# EasyEDA Pro project ProProject_IMUSensorNodes202312.epro, board 6_6_拼板20240123（带编号） (continued)
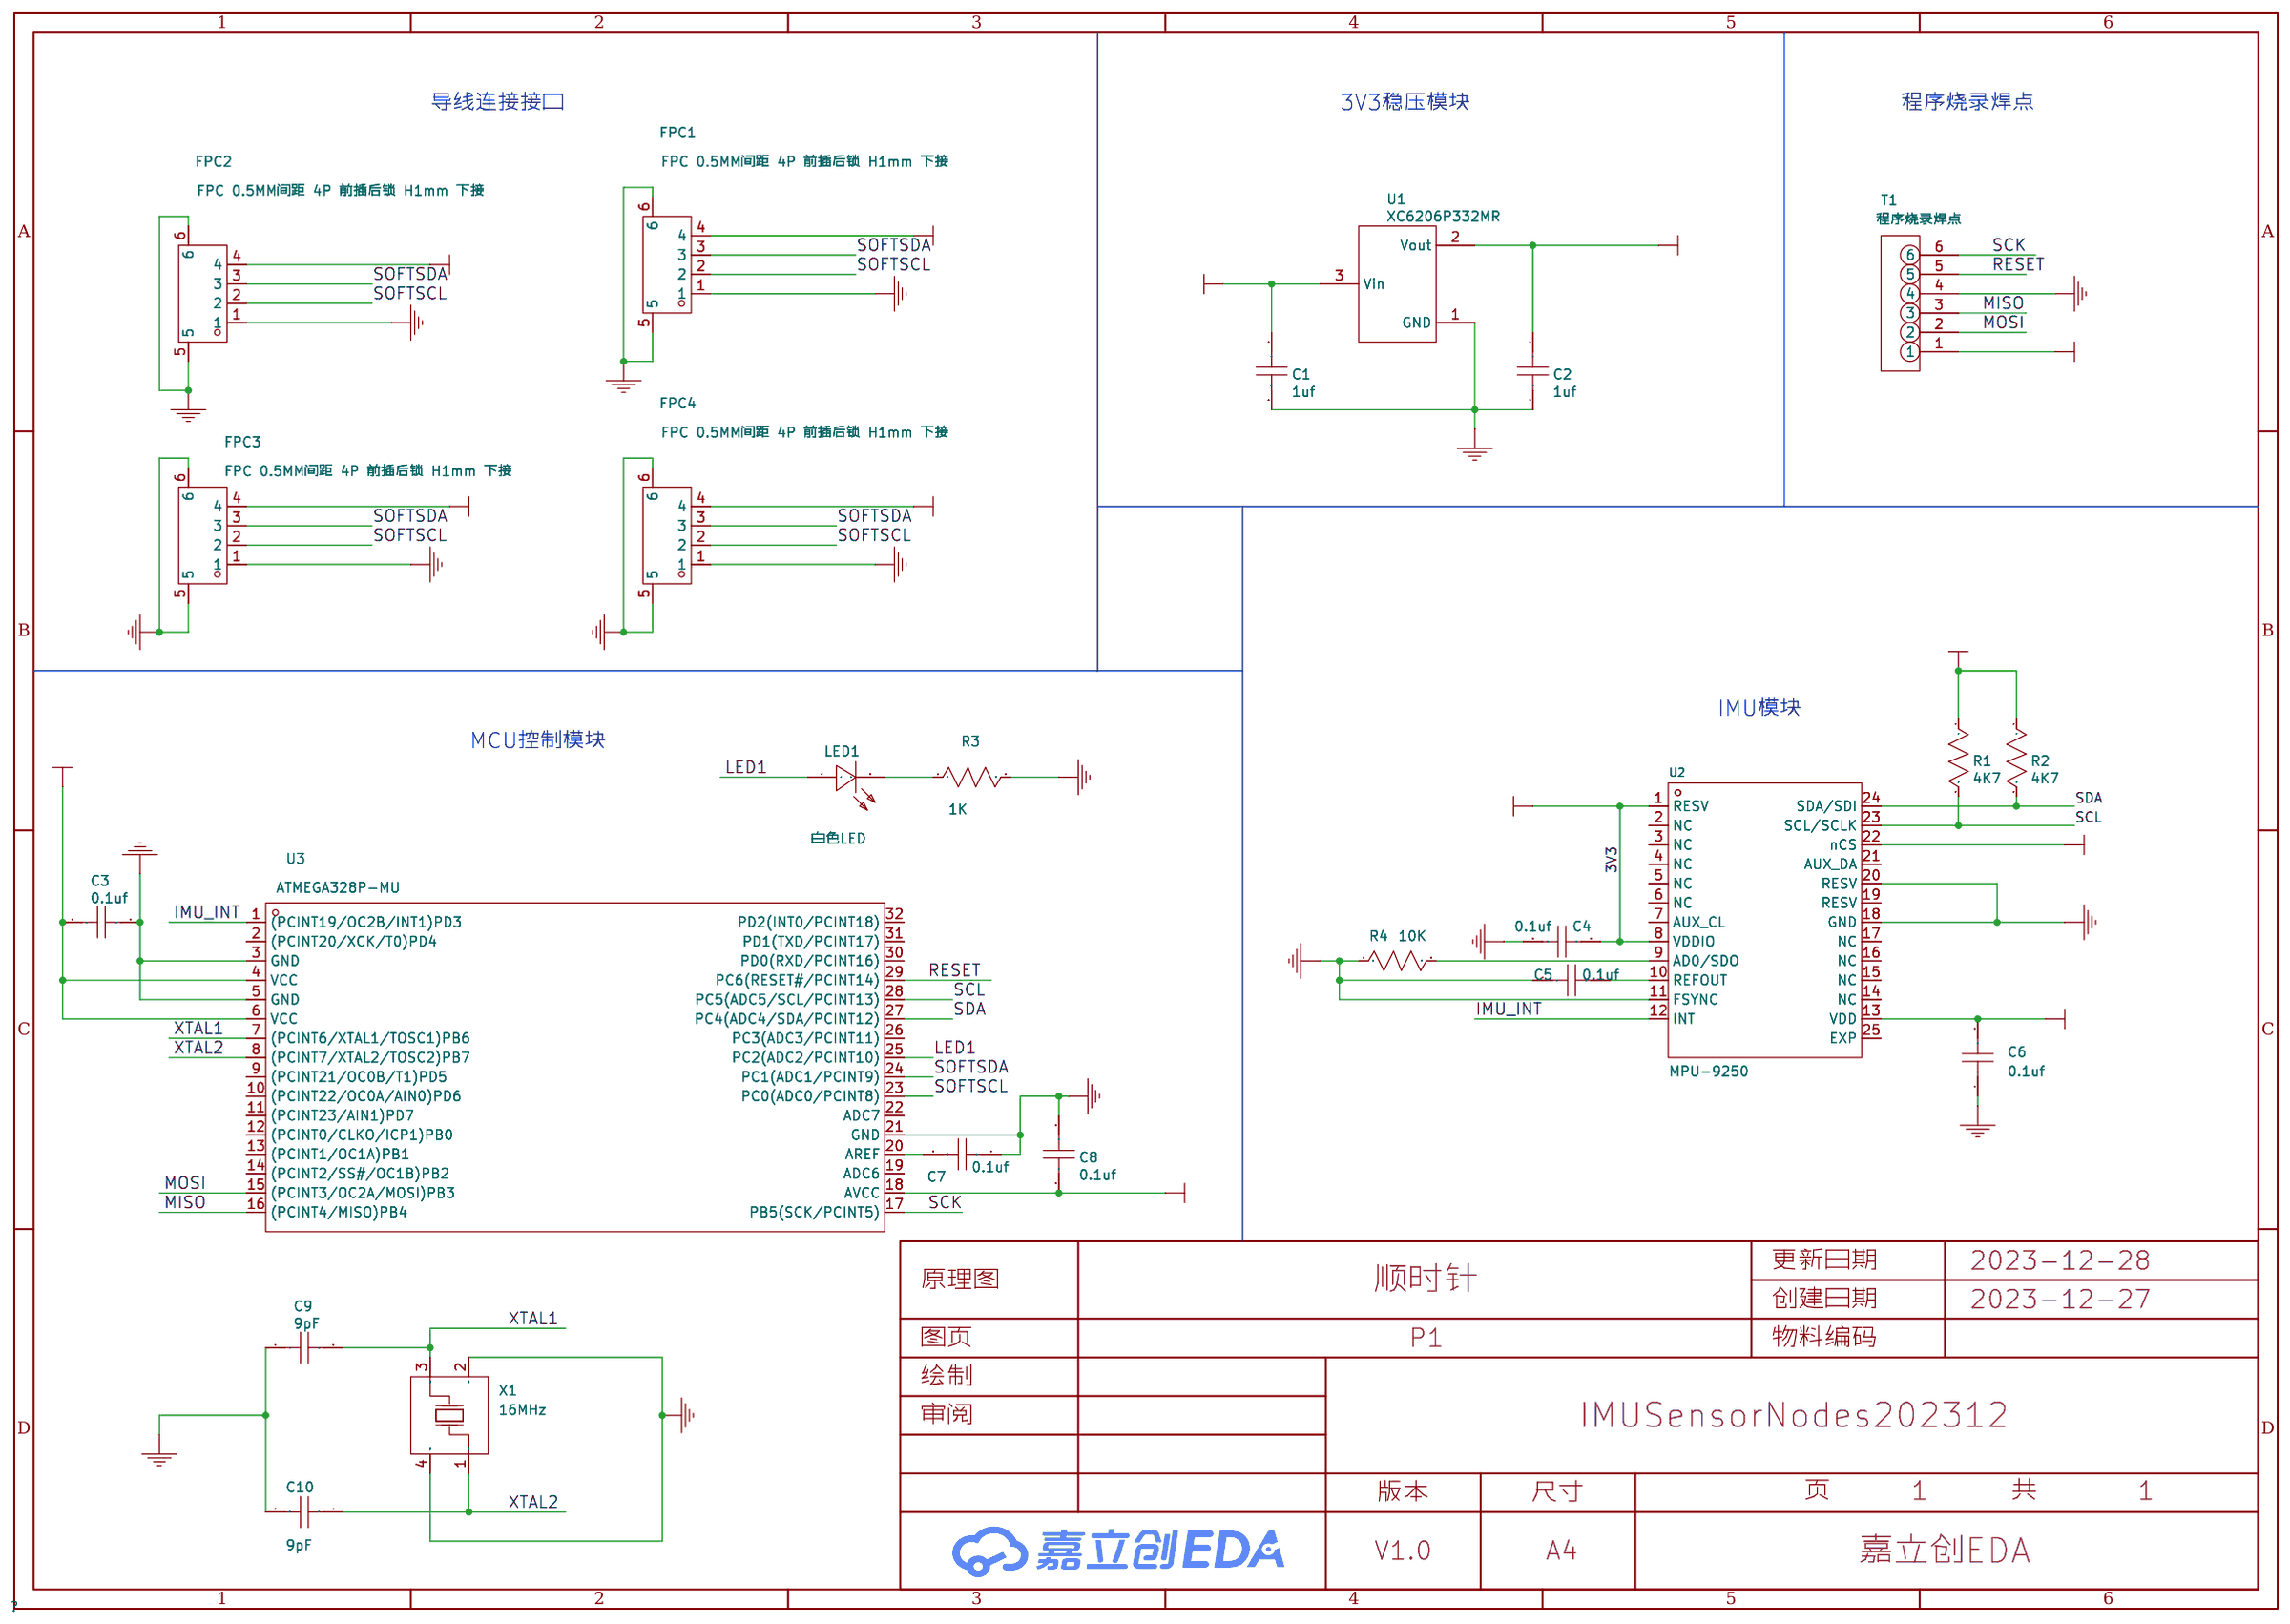
[diagram p0: schematic sheet]
## Routing (per net, layer and track width the routed paths; a pad name or vN(x,y) marks a point on that pad's centre or on a via; arc(x,y) is an arc through that point) (continued)
IMU_INT: length 484.8
  Top Layer w0.127: v2(1.68,5.11) 1.55,5.24 1.55,7.26 3.32,9.03 3.32,10.05 3.71,10.44 6.42,10.44 v1(6.72,10.74) ; v1(15.52,6.38) 15.52,7.14 16.41,8.03 16.41,8.33 18.4,10.32 18.7,10.32 19.12,10.74 v1(20.43,10.74) ; v1(70.13,6.38) 70.13,7.14 71.02,8.03 71.02,8.33 73.01,10.32 73.31,10.32 73.73,10.74 v1(75.04,10.74) ; v1(70.13,74.96) 70.13,75.72 71.02,76.61 71.02,76.91 73.01,78.9 73.31,78.9 73.73,79.32 v1(75.04,79.32) ; v1(20.43,24.45) 19.12,24.45 18.7,24.03 18.4,24.03 16.41,22.05 16.41,21.75 15.52,20.86 v1(15.52,20.09) ; v1(6.72,38.17) 6.42,37.88 3.71,37.88 3.32,37.48 3.32,36.46 1.55,34.69 1.55,32.67 v2(1.68,32.54) ; v1(42.83,20.09) 42.83,20.86 43.72,21.75 43.72,22.05 45.7,24.03 46,24.03 46.43,24.45 v1(47.74,24.45) ; v1(42.83,74.96) 42.83,75.72 43.72,76.61 43.72,76.91 45.7,78.9 46,78.9 46.43,79.32 v1(47.74,79.32) ; v2(28.99,46.26) 28.86,46.38 28.86,48.41 30.63,50.18 30.63,51.2 31.02,51.59 33.72,51.59 v1(34.02,51.89) ; v2(56.29,73.69) 56.16,73.82 56.16,75.84 57.93,77.61 57.93,78.63 58.32,79.02 61.03,79.02 v1(61.33,79.32) ; v1(47.74,51.89) 46.43,51.89 46,51.46 45.7,51.46 43.72,49.48 43.72,49.18 42.83,48.29 v1(42.83,47.53) ; v1(15.52,61.24) 15.52,62 16.41,62.89 16.41,63.2 18.4,65.18 18.7,65.18 19.12,65.6 v1(20.43,65.6) ; v1(20.43,79.32) 19.12,79.32 18.7,78.9 18.4,78.9 16.41,76.91 16.41,76.61 15.52,75.72 v1(15.52,74.96) ; v1(61.33,51.89) 61.03,51.59 58.32,51.59 57.93,51.2 57.93,50.18 56.16,48.41 56.16,46.38 v2(56.29,46.26) ; v1(61.33,65.6) 61.03,65.31 58.32,65.31 57.93,64.92 57.93,63.89 56.16,62.12 56.16,60.1 v2(56.29,59.97) ; v1(47.74,65.6) 46.43,65.6 46,65.18 45.7,65.18 43.72,63.2 43.72,62.89 42.83,62 v1(42.83,61.24) ; v2(28.99,59.97) 28.86,60.1 28.86,62.12 30.63,63.89 30.63,64.92 31.02,65.31 33.72,65.31 v1(34.02,65.6) ; v1(70.13,33.81) 70.13,34.57 71.02,35.46 71.02,35.76 73.01,37.75 73.31,37.75 73.73,38.17 v1(75.04,38.17) ; v1(15.52,33.81) 15.52,34.57 16.41,35.46 16.41,35.76 18.4,37.75 18.7,37.75 19.12,38.17 v1(20.43,38.17) ; v1(70.13,20.09) 70.13,20.86 71.02,21.75 71.02,22.05 73.01,24.03 73.31,24.03 73.73,24.45 v1(75.04,24.45) ; v1(6.72,24.46) 6.42,24.16 3.71,24.16 3.32,23.77 3.32,22.74 1.55,20.98 1.55,18.95 v2(1.68,18.82) ; v1(47.74,10.74) 46.43,10.74 46,10.32 45.7,10.32 43.72,8.33 43.72,8.03 42.83,7.14 v1(42.83,6.38) ; v1(75.04,65.6) 73.73,65.6 73.31,65.18 73.01,65.18 71.02,63.2 71.02,62.89 70.13,62 v1(70.13,61.24) ; v2(28.99,73.69) 28.86,73.82 28.86,75.84 30.63,77.61 30.63,78.63 31.02,79.02 33.72,79.02 v1(34.02,79.32) ; v2(1.68,73.69) 1.55,73.82 1.55,75.84 3.32,77.61 3.32,78.63 3.71,79.02 6.42,79.02 v1(6.72,79.32) ; v1(61.33,38.17) 61.03,37.88 58.32,37.88 57.93,37.48 57.93,36.46 56.16,34.69 56.16,32.67 v2(56.29,32.54) ; v1(47.74,38.17) 46.43,38.17 46,37.75 45.7,37.75 43.72,35.76 43.72,35.46 42.83,34.57 v1(42.83,33.81) ; v1(75.04,51.89) 73.73,51.89 73.31,51.46 73.01,51.46 71.02,49.48 71.02,49.18 70.13,48.29 v1(70.13,47.53) ; v1(20.43,51.89) 19.12,51.89 18.7,51.46 18.4,51.46 16.41,49.48 16.41,49.18 15.52,48.29 v1(15.52,47.53) ; v1(34.02,24.46) 33.72,24.16 31.02,24.16 30.63,23.77 30.63,22.74 28.86,20.98 28.86,18.95 v2(28.99,18.82) ; v2(28.99,32.54) 28.86,32.67 28.86,34.69 30.63,36.46 30.63,37.48 31.02,37.88 33.72,37.88 v1(34.02,38.17) ; v2(1.68,59.97) 1.55,60.1 1.55,62.12 3.32,63.89 3.32,64.92 3.71,65.31 6.42,65.31 v1(6.72,65.6) ; v2(1.68,46.26) 1.55,46.38 1.55,48.41 3.32,50.18 3.32,51.2 3.71,51.59 6.42,51.59 v1(6.72,51.89) ; v1(61.33,10.74) 61.03,10.44 58.32,10.44 57.93,10.05 57.93,9.03 56.16,7.26 56.16,5.24 v2(56.29,5.11) ; v1(61.33,24.46) 61.03,24.16 58.32,24.16 57.93,23.77 57.93,22.74 56.16,20.98 56.16,18.95 v2(56.29,18.82) ; v2(28.99,5.11) 28.86,5.24 28.86,7.26 30.63,9.03 30.63,10.05 31.02,10.44 33.72,10.44 v1(34.02,10.74)
  Bottom Layer w0.127: Designator#831.12 34.84,8.43 35.34,8.92 35.34,10.06 35.29,10.11 35.29,10.29 35.14,10.44 34.32,10.44 v1(34.02,10.74) ; v1(47.74,38.17) 47.91,38 48.67,38 48.97,37.71 48.97,36.31 48.26,35.6 47.31,35.6 Designator#882.12 ; Designator#921.12 34.84,35.86 35.34,36.35 35.34,37.49 35.29,37.55 35.29,37.72 35.14,37.88 34.32,37.88 v1(34.02,38.17) ; v1(6.72,38.17) 7.01,37.88 7.83,37.88 7.98,37.72 7.98,37.55 8.03,37.49 8.03,36.35 7.54,35.86 Designator#317.12 ; v1(34.02,51.89) 34.32,51.59 35.14,51.59 35.29,51.44 35.29,51.26 35.34,51.21 35.34,50.07 34.84,49.58 Designator#319.12 ; v1(20.43,38.17) 20.6,38 21.37,38 21.66,37.71 21.66,36.31 20.95,35.6 20.01,35.6 Designator#923.12 ; Designator#314.12 47.31,63.03 48.26,63.03 48.97,63.74 48.97,65.14 48.67,65.43 47.91,65.43 v1(47.74,65.6) ; v1(47.74,79.32) 47.91,79.15 48.67,79.15 48.97,78.85 48.97,77.45 48.26,76.75 47.31,76.75 Designator#880.12 ; Designator#813.12 47.31,21.88 48.26,21.88 48.97,22.59 48.97,23.99 48.67,24.29 47.91,24.29 v1(47.74,24.45) ; v1(61.33,10.74) 61.62,10.44 62.44,10.44 62.59,10.29 62.59,10.11 62.64,10.06 62.64,8.92 62.15,8.43 Designator#911.12 ; v1(20.43,10.74) 20.6,10.57 21.37,10.57 21.66,10.27 21.66,8.87 20.95,8.16 20.01,8.16 Designator#323.12 ; v1(75.04,65.6) 75.21,65.43 75.98,65.43 76.27,65.14 76.27,63.74 75.56,63.03 74.62,63.03 Designator#881.12 ; Designator#918.12 74.62,76.75 75.56,76.75 76.27,77.45 76.27,78.85 75.98,79.15 75.21,79.15 v1(75.04,79.32) ; Designator#878.12 34.84,63.29 35.34,63.78 35.34,64.93 35.29,64.98 35.29,65.16 35.14,65.31 34.32,65.31 v1(34.02,65.6) ; v1(61.33,79.32) 61.62,79.02 62.44,79.02 62.59,78.87 62.59,78.69 62.64,78.64 62.64,77.5 62.15,77.01 Designator#814.12 ; Designator#919.12 62.15,35.86 62.64,36.35 62.64,37.49 62.59,37.55 62.59,37.72 62.44,37.88 61.62,37.88 v1(61.33,38.17) ; Designator#437.12 7.54,77.01 8.03,77.5 8.03,78.64 7.98,78.69 7.98,78.87 7.83,79.02 7.01,79.02 v1(6.72,79.32) ; v1(75.04,24.45) 75.21,24.29 75.98,24.29 76.27,23.99 76.27,22.59 75.56,21.88 74.62,21.88 Designator#883.12 ; v1(47.74,10.74) 47.91,10.57 48.67,10.57 48.97,10.27 48.97,8.87 48.26,8.16 47.31,8.16 Designator#326.12 ; Designator#890.12 20.01,49.31 20.95,49.31 21.66,50.02 21.66,51.42 21.37,51.72 20.6,51.72 v1(20.43,51.89) ; v1(20.43,65.6) 20.6,65.43 21.37,65.43 21.66,65.14 21.66,63.74 20.95,63.03 20.01,63.03 Designator#915.12 ; Designator#877.12 62.15,49.58 62.64,50.07 62.64,51.21 62.59,51.26 62.59,51.44 62.44,51.59 61.62,51.59 v1(61.33,51.89) ; Designator#830.12 74.62,35.6 75.56,35.6 76.27,36.31 76.27,37.71 75.98,38 75.21,38 v1(75.04,38.17) ; v1(34.02,24.46) 34.32,24.16 35.14,24.16 35.29,24.01 35.29,23.83 35.34,23.78 35.34,22.64 34.84,22.14 Designator#909.12 ; v1(47.74,51.89) 47.91,51.72 48.67,51.72 48.97,51.42 48.97,50.02 48.26,49.31 47.31,49.31 Designator#897.12 ; Designator#886.12 20.01,76.75 20.95,76.75 21.66,77.45 21.66,78.85 21.37,79.15 20.6,79.15 v1(20.43,79.32) ; Designator#819.12 62.15,63.29 62.64,63.78 62.64,64.93 62.59,64.98 62.59,65.16 62.44,65.31 61.62,65.31 v1(61.33,65.6) ; Designator#438.12 7.54,8.43 8.03,8.92 8.03,10.06 7.98,10.11 7.98,10.29 7.83,10.44 7.01,10.44 v1(6.72,10.74) ; Designator#900.12 62.15,22.14 62.64,22.64 62.64,23.78 62.59,23.83 62.59,24.01 62.44,24.16 61.62,24.16 v1(61.33,24.46) ; v1(6.72,51.89) 7.01,51.59 7.83,51.59 7.98,51.44 7.98,51.26 8.03,51.21 8.03,50.07 7.54,49.58 Designator#888.12 ; Designator#818.12 7.54,63.29 8.03,63.78 8.03,64.93 7.98,64.98 7.98,65.16 7.83,65.31 7.01,65.31 v1(6.72,65.6) ; v1(75.04,51.89) 75.21,51.72 75.98,51.72 76.27,51.42 76.27,50.02 75.56,49.31 74.62,49.31 Designator#912.12 ; Designator#318.12 7.54,22.14 8.03,22.64 8.03,23.78 7.98,23.83 7.98,24.01 7.83,24.16 7.01,24.16 v1(6.72,24.46) ; v1(75.04,10.74) 75.21,10.57 75.98,10.57 76.27,10.27 76.27,8.87 75.56,8.16 74.62,8.16 Designator#826.12 ; v1(20.43,24.45) 20.6,24.29 21.37,24.29 21.66,23.99 21.66,22.59 20.95,21.88 20.01,21.88 Designator#836.12 ; v1(34.02,79.32) 34.32,79.02 35.14,79.02 35.29,78.87 35.29,78.69 35.34,78.64 35.34,77.5 34.84,77.01 Designator#901.12
LED1:
  vias: v1(1.17,70.77) v1(1.17,57.05) v1(1.17,43.34) v1(1.17,29.62) v1(1.17,15.9) v1(1.17,2.19) v1(15.14,70.39) v1(15.14,56.67) v1(15.14,42.95) v1(15.14,29.24) v1(15.14,15.52) v1(15.14,1.81) v1(28.48,70.77) v1(28.48,57.05) v1(28.48,43.34) v1(28.48,29.62) v1(28.48,15.9) v1(28.48,2.19) v1(42.45,70.39) v1(42.45,56.67) v1(42.45,42.95) v1(42.45,29.24) v1(42.45,15.52) v1(42.45,1.81) v1(55.78,70.77) v1(55.78,57.05) v1(55.78,43.34) v1(55.78,29.62) v1(55.78,15.9) v1(55.78,2.19) v1(69.75,70.39) v1(69.75,56.67) v1(69.75,42.95) v1(69.75,29.24) v1(69.75,15.52) v1(69.75,1.81)
MISO:
  vias: v1(9.4,70.44) v1(9.4,56.72) v1(9.4,43) v1(9.4,29.29) v1(9.4,15.57) v1(9.4,1.86) v1(23.12,70.44) v1(23.12,56.72) v1(23.12,43) v1(23.12,29.29) v1(23.12,15.57) v1(23.12,1.86) v1(36.71,70.44) v1(36.71,56.72) v1(36.71,43) v1(36.71,29.29) v1(36.71,15.57) v1(36.71,1.86) v1(50.42,70.44) v1(50.42,56.72) v1(50.42,43) v1(50.42,29.29) v1(50.42,15.57) v1(50.42,1.86) v1(64.01,70.44) v1(64.01,56.72) v1(64.01,43) v1(64.01,29.29) v1(64.01,15.57) v1(64.01,1.86) v1(77.73,70.44) v1(77.73,56.72) v1(77.73,43) v1(77.73,29.29) v1(77.73,15.57) v1(77.73,1.86)
MOSI:
  vias: v1(9.4,71.71) v1(9.4,57.99) v1(9.4,44.27) v1(9.4,30.56) v1(9.4,16.84) v1(9.4,3.13) v1(23.12,71.71) v1(23.12,57.99) v1(23.12,44.27) v1(23.12,30.56) v1(23.12,16.84) v1(23.12,3.13) v1(36.71,71.71) v1(36.71,57.99) v1(36.71,44.27) v1(36.71,30.56) v1(36.71,16.84) v1(36.71,3.13) v1(50.42,71.71) v1(50.42,57.99) v1(50.42,44.27) v1(50.42,30.56) v1(50.42,16.84) v1(50.42,3.13) v1(64.01,71.71) v1(64.01,57.99) v1(64.01,44.27) v1(64.01,30.56) v1(64.01,16.84) v1(64.01,3.13) v1(77.73,71.71) v1(77.73,57.99) v1(77.73,44.27) v1(77.73,30.56) v1(77.73,16.84) v1(77.73,3.13)
RESET: length 163.4
  Top Layer w0.2: v1(43.21,59.21) 43.47,58.96 43.47,56.92 42.93,56.39 42.93,55.94 43.34,55.53 44.96,55.53 Designator#240.5 ; v1(70.52,18.06) 70.77,17.81 70.77,15.78 70.23,15.24 70.23,14.79 70.64,14.38 72.27,14.38 Designator#222.5 ; v1(51.69,16.84) 51.09,16.23 51.09,14.89 50.58,14.38 ; Designator#105.5 17.66,0.66 16.03,0.66 15.62,1.07 15.62,1.53 16.16,2.06 16.16,4.09 v1(15.91,4.35) ; Designator#85.5 72.27,41.81 70.64,41.81 70.23,42.22 70.23,42.67 70.77,43.21 70.77,45.24 v1(70.52,45.5) ; Designator#7.5 17.66,55.53 16.03,55.53 15.62,55.94 15.62,56.39 16.16,56.92 16.16,58.96 v1(15.91,59.21) ; v1(79,57.99) 78.39,57.38 78.39,56.04 77.88,55.53 ; Designator#101.5 17.66,41.81 16.03,41.81 15.62,42.22 15.62,42.67 16.16,43.21 16.16,45.24 v1(15.91,45.5) ; 50.58,28.1 51.09,28.6 51.09,29.95 v1(51.69,30.56) ; 23.27,14.38 23.78,14.89 23.78,16.23 v1(24.39,16.84) ; 23.27,28.1 23.78,28.6 23.78,29.95 v1(24.39,30.56) ; v1(43.21,72.93) 43.47,72.67 43.47,70.64 42.93,70.11 42.93,69.65 43.34,69.24 44.96,69.24 Designator#8.5 ; v1(43.21,4.35) 43.47,4.09 43.47,2.06 42.93,1.53 42.93,1.07 43.34,0.66 44.96,0.66 Designator#163.5 ; v1(79,71.71) 78.39,71.1 78.39,69.75 77.88,69.24 ; Designator#88.5 72.27,69.24 70.64,69.24 70.23,69.65 70.23,70.11 70.77,70.64 70.77,72.67 v1(70.52,72.93) ; 77.88,28.1 78.39,28.6 78.39,29.95 v1(79,30.56) ; 23.27,69.24 23.78,69.75 23.78,71.1 v1(24.39,71.71) ; 50.58,41.81 51.09,42.32 51.09,43.67 v1(51.69,44.27) ; v1(79,16.84) 78.39,16.23 78.39,14.89 77.88,14.38 ; v1(51.69,71.71) 51.09,71.1 51.09,69.75 50.58,69.24 ; v1(43.21,45.5) 43.47,45.24 43.47,43.21 42.93,42.67 42.93,42.22 43.34,41.81 44.96,41.81 Designator#224.5 ; 50.58,0.66 51.09,1.17 51.09,2.52 v1(51.69,3.13) ; v1(24.39,57.99) 23.78,57.38 23.78,56.04 23.27,55.53 ; v1(43.21,18.06) 43.47,17.81 43.47,15.78 42.93,15.24 42.93,14.79 43.34,14.38 44.96,14.38 Designator#16.5 ; v1(15.91,18.06) 16.16,17.81 16.16,15.78 15.62,15.24 15.62,14.79 16.03,14.38 17.66,14.38 Designator#161.5 ; Designator#293.5 17.66,69.24 16.03,69.24 15.62,69.65 15.62,70.11 16.16,70.64 16.16,72.67 v1(15.91,72.93) ; v1(70.52,31.78) 70.77,31.53 70.77,29.49 70.23,28.96 70.23,28.5 70.64,28.1 72.27,28.1 Designator#96.5 ; v1(43.21,31.78) 43.47,31.53 43.47,29.49 42.93,28.96 42.93,28.5 43.34,28.1 44.96,28.1 Designator#107.5 ; v1(24.39,3.13) 23.78,2.52 23.78,1.17 23.27,0.66 ; 77.88,41.81 78.39,42.32 78.39,43.67 v1(79,44.27) ; Designator#223.5 72.27,0.66 70.64,0.66 70.23,1.07 70.23,1.53 70.77,2.06 70.77,4.09 v1(70.52,4.35) ; v1(79,3.13) 78.39,2.52 78.39,1.17 77.88,0.66 ; v1(51.69,57.99) 51.09,57.38 51.09,56.04 50.58,55.53 ; Designator#236.5 72.27,55.53 70.64,55.53 70.23,55.94 70.23,56.39 70.77,56.92 70.77,58.96 v1(70.52,59.21) ; v1(24.39,44.27) 23.78,43.67 23.78,42.32 23.27,41.81 ; Designator#10.5 17.66,28.1 16.03,28.1 15.62,28.5 15.62,28.96 16.16,29.49 16.16,31.53 v1(15.91,31.78)
  vias: v1(2.32,72.84) v1(2.32,59.12) v1(2.32,45.41) v1(2.32,31.69) v1(2.32,17.97) v1(2.32,4.26) v1(10.67,71.71) v1(10.67,57.99) v1(10.67,44.27) v1(10.67,30.56) v1(10.67,16.84) v1(10.67,3.13) v1(29.62,72.84) v1(29.62,59.12) v1(29.62,45.41) v1(29.62,31.69) v1(29.62,17.97) v1(29.62,4.26) v1(37.98,71.71) v1(37.98,57.99) v1(37.98,44.27) v1(37.98,30.56) v1(37.98,16.84) v1(37.98,3.13) v1(56.93,72.84) v1(56.93,59.12) v1(56.93,45.41) v1(56.93,31.69) v1(56.93,17.97) v1(56.93,4.26) v1(65.28,71.71) v1(65.28,57.99) v1(65.28,44.27) v1(65.28,30.56) v1(65.28,16.84) v1(65.28,3.13)
SCK: length 93.7
  Bottom Layer w0.2: v1(51.69,15.57) 51.69,15.24 51.47,15.01 49.94,15.01 49.56,15.4 47.24,15.4 Designator#885.17 ; v1(24.39,1.86) 24.39,1.53 24.16,1.3 22.64,1.3 22.26,1.68 19.94,1.68 Designator#913.17 ; v1(24.39,29.29) 24.39,28.96 24.16,28.73 22.64,28.73 22.26,29.11 19.94,29.11 Designator#822.17 ; Designator#889.17 47.24,70.26 49.56,70.26 49.94,69.88 51.47,69.88 51.69,70.11 v1(51.69,70.44) ; v1(51.69,29.29) 51.69,28.96 51.47,28.73 49.94,28.73 49.56,29.11 47.24,29.11 Designator#839.17 ; v1(24.39,43) 24.39,42.67 24.16,42.45 22.64,42.45 22.26,42.83 19.94,42.83 Designator#902.17 ; Designator#324.17 47.24,56.54 49.56,56.54 49.94,56.16 51.47,56.16 51.69,56.39 v1(51.69,56.72) ; v1(51.69,43) 51.69,42.67 51.47,42.45 49.94,42.45 49.56,42.83 47.24,42.83 Designator#322.17 ; v1(79,56.72) 79,56.39 78.77,56.16 77.25,56.16 76.87,56.54 74.55,56.54 Designator#809.17 ; v1(51.69,1.86) 51.69,1.53 51.47,1.3 49.94,1.3 49.56,1.68 47.24,1.68 Designator#838.17 ; v1(24.39,56.72) 24.39,56.39 24.16,56.16 22.64,56.16 22.26,56.54 19.94,56.54 Designator#835.17 ; v1(79,15.57) 79,15.24 78.77,15.01 77.25,15.01 76.87,15.4 74.55,15.4 Designator#895.17 ; v1(24.39,15.57) 24.39,15.24 24.16,15.01 22.64,15.01 22.26,15.4 19.94,15.4 Designator#904.17 ; v1(24.39,70.44) 24.39,70.11 24.16,69.88 22.64,69.88 22.26,70.26 19.94,70.26 Designator#820.17 ; Designator#910.17 74.55,1.68 76.87,1.68 77.25,1.3 78.77,1.3 79,1.53 v1(79,1.86) ; v1(79,29.29) 79,28.96 78.77,28.73 77.25,28.73 76.87,29.11 74.55,29.11 Designator#801.17 ; Designator#810.17 74.55,70.26 76.87,70.26 77.25,69.88 78.77,69.88 79,70.11 v1(79,70.44) ; v1(79,43) 79,42.67 78.77,42.45 77.25,42.45 76.87,42.83 74.55,42.83 Designator#906.17
  vias: v1(10.67,70.44) v1(10.67,56.72) v1(10.67,43) v1(10.67,29.29) v1(10.67,15.57) v1(10.67,1.86) v1(37.98,70.44) v1(37.98,56.72) v1(37.98,43) v1(37.98,29.29) v1(37.98,15.57) v1(37.98,1.86) v1(65.28,70.44) v1(65.28,56.72) v1(65.28,43) v1(65.28,29.29) v1(65.28,15.57) v1(65.28,1.86)
SCL: length 301.1
  Bottom Layer w0.2: Designator#313.28 28.73,72.3 28.35,72.67 28.35,77.25 29.39,78.29 Designator#392.2 29.61,78.61 Designator#901.23 ; Designator#909.23 29.61,23.74 Designator#354.2 29.39,23.42 28.35,22.38 28.35,17.81 28.73,17.43 Designator#321.28 ; Designator#878.23 29.61,64.89 Designator#404.2 29.39,64.57 28.35,63.53 28.35,58.96 28.73,58.58 Designator#808.28 ; Designator#829.28 56.03,17.43 55.66,17.81 55.66,22.38 56.7,23.42 Designator#360.2 56.92,23.74 Designator#900.23 ; Designator#911.23 56.92,10.03 Designator#377.2 56.7,9.71 55.66,8.66 55.66,4.09 56.03,3.72 Designator#832.28 ; Designator#888.23 2.31,51.17 Designator#416.2 2.09,50.85 1.05,49.81 1.05,45.24 1.42,44.86 Designator#803.28 ; Designator#827.28 28.73,31.15 28.35,31.53 28.35,36.1 29.39,37.14 Designator#333.2 29.61,37.46 Designator#921.23 ; Designator#892.28 56.03,31.15 55.66,31.53 55.66,36.1 56.7,37.14 Designator#339.2 56.92,37.46 Designator#919.23 ; Designator#818.23 2.31,64.89 Designator#398.2 2.09,64.57 1.05,63.53 1.05,58.96 1.42,58.58 Designator#811.28 ; Designator#917.28 1.42,3.72 1.05,4.09 1.05,8.66 2.09,9.71 Designator#365.2 2.31,10.03 Designator#438.23 ; Designator#877.23 56.92,51.17 Designator#428.2 56.7,50.85 55.66,49.81 55.66,45.24 56.03,44.86 Designator#920.28 ; Designator#806.28 28.73,3.72 28.35,4.09 28.35,8.66 29.39,9.71 Designator#371.2 29.61,10.03 Designator#831.23 ; Designator#317.23 2.31,37.46 Designator#434.2 2.09,37.14 1.05,36.1 1.05,31.53 1.42,31.15 Designator#440.28 ; Designator#437.23 2.31,78.61 Designator#383.2 2.09,78.29 1.05,77.25 1.05,72.67 1.42,72.3 Designator#325.28 ; Designator#814.23 56.92,78.61 Designator#386.2 56.7,78.29 55.66,77.25 55.66,72.67 56.03,72.3 Designator#903.28 ; Designator#318.23 2.31,23.74 Designator#348.2 2.09,23.42 1.05,22.38 1.05,17.81 1.42,17.43 Designator#837.28 ; Designator#896.28 56.03,58.58 55.66,58.96 55.66,63.53 56.7,64.57 Designator#410.2 56.92,64.89 Designator#819.23 ; Designator#916.28 28.73,44.86 28.35,45.24 28.35,49.81 29.39,50.85 Designator#422.2 29.61,51.17 Designator#319.23
  Bottom Layer w0.254: Designator#881.23 70.99,64.89 70.77,64.67 Designator#413.2 70.67,64.57 69.22,63.12 69.22,59.11 69.75,58.58 Designator#809.28 ; Designator#322.28 42.44,44.86 41.92,45.39 41.92,49.41 43.36,50.85 Designator#425.2 43.47,50.96 43.68,51.17 Designator#897.23 ; Designator#902.28 15.14,44.86 14.61,45.39 14.61,49.41 16.06,50.85 Designator#419.2 16.16,50.96 16.38,51.17 Designator#890.23 ; Designator#801.28 69.75,31.15 69.22,31.68 69.22,35.69 70.67,37.14 Designator#342.2 70.77,37.24 70.99,37.46 Designator#830.23 ; Designator#839.28 42.44,31.15 41.92,31.68 41.92,35.69 43.36,37.14 Designator#336.2 43.47,37.24 43.68,37.46 Designator#882.23 ; Designator#904.28 15.14,17.43 14.61,17.96 14.61,21.97 16.06,23.42 Designator#351.2 16.16,23.52 16.38,23.74 Designator#836.23 ; Designator#913.28 15.14,3.72 14.61,4.25 14.61,8.26 16.06,9.71 Designator#368.2 16.16,9.81 16.38,10.03 Designator#323.23 ; Designator#820.28 15.14,72.3 14.61,72.83 14.61,76.84 16.06,78.29 Designator#389.2 16.16,78.39 16.38,78.61 Designator#886.23 ; Designator#810.28 69.75,72.3 69.22,72.83 69.22,76.84 70.67,78.29 Designator#345.2 70.77,78.39 70.99,78.61 Designator#918.23 ; Designator#923.23 16.38,37.46 16.16,37.24 Designator#330.2 16.06,37.14 14.61,35.69 14.61,31.68 15.14,31.15 Designator#822.28 ; Designator#883.23 70.99,23.74 70.77,23.52 Designator#363.2 70.67,23.42 69.22,21.97 69.22,17.96 69.75,17.43 Designator#895.28 ; Designator#910.28 69.75,3.72 69.22,4.25 69.22,8.26 70.67,9.71 Designator#380.2 70.77,9.81 70.99,10.03 Designator#826.23 ; Designator#813.23 43.68,23.74 43.47,23.52 Designator#357.2 43.36,23.42 41.92,21.97 41.92,17.96 42.44,17.43 Designator#885.28 ; Designator#326.23 43.68,10.03 43.47,9.81 Designator#374.2 43.36,9.71 41.92,8.26 41.92,4.25 42.44,3.72 Designator#838.28 ; Designator#906.28 69.75,44.86 69.22,45.39 69.22,49.41 70.67,50.85 Designator#431.2 70.77,50.96 70.99,51.17 Designator#912.23 ; Designator#915.23 16.38,64.89 16.16,64.67 Designator#401.2 16.06,64.57 14.61,63.12 14.61,59.11 15.14,58.58 Designator#835.28 ; Designator#314.23 43.68,64.89 43.47,64.67 Designator#407.2 43.36,64.57 41.92,63.12 41.92,59.11 42.44,58.58 Designator#324.28 ; Designator#889.28 42.44,72.3 41.92,72.83 41.92,76.84 43.36,78.29 Designator#395.2 43.47,78.39 43.68,78.61 Designator#880.23
SDA: length 420.6
  Bottom Layer w0.2: 56.72,51.58 56.24,51.58 ; 56.72,51.58 56.7,51.6 56.7,52.02 ; 56.72,51.58 57.14,51.58 ; 56.24,51.58 56.02,51.58 55.66,51.21 55.48,51.21 55.15,50.88 55.15,45.24 56.03,44.36 Designator#920.27 ; 56.24,51.58 arc(56.56,51.71) 56.7,52.04 ; 56.7,65.73 56.7,65.31 56.72,65.29 ; 56.7,65.73 56.7,65.75 ; 56.7,65.73 arc(56.83,65.42) 57.14,65.29 ; 28.93,65.29 28.72,65.29 28.35,64.93 28.17,64.93 27.84,64.6 27.84,58.96 28.72,58.08 Designator#808.27 ; 28.93,65.29 29.41,65.29 ; 28.93,65.29 arc(29.26,65.43) 29.39,65.75 ; 2.11,51.58 2.09,51.6 2.09,52.02 ; 2.11,51.58 2.53,51.58 ; 2.11,51.58 1.63,51.58 ; 29.84,10.43 29.41,10.43 ; 29.84,10.43 Designator#831.24 ; 29.84,10.43 arc(29.52,10.56) 29.39,10.87 ; 29.41,10.43 28.93,10.43 ; 29.41,10.43 29.39,10.45 29.39,10.87 ; Designator#338.2 56.7,38.32 ; 56.7,38.32 56.7,38.3 ; 56.7,38.32 arc(56.56,37.99) 56.24,37.86 ; Designator#332.2 29.39,38.32 ; 29.39,38.32 29.39,38.3 ; 29.39,38.32 arc(29.26,37.99) 28.93,37.86 ; Designator#347.2 2.09,24.6 ; 2.09,24.6 2.09,24.59 ; 2.09,24.6 arc(1.95,24.28) 1.63,24.14 ; 28.93,79.01 28.72,79.01 28.35,78.64 28.17,78.64 27.84,78.31 27.84,72.67 28.72,71.8 Designator#313.27 ; 28.93,79.01 29.41,79.01 ; 28.93,79.01 arc(29.26,79.14) 29.39,79.47 ; Designator#917.27 1.42,3.22 0.54,4.09 0.54,9.73 0.87,10.06 1.05,10.06 1.41,10.43 1.63,10.43 ; Designator#438.24 2.53,10.43 ; 2.53,10.43 2.11,10.43 ; 2.53,10.43 arc(2.22,10.56) 2.09,10.87 ; 56.7,79.45 56.7,79.03 56.72,79.01 ; 56.7,79.45 56.7,79.47 ; 56.7,79.45 arc(56.83,79.14) 57.14,79.01 ; 2.09,24.59 2.09,24.16 2.11,24.14 ; 2.09,24.59 arc(2.22,24.27) 2.53,24.14 ; 29.41,51.58 29.39,51.6 29.39,52.02 ; 29.41,51.58 28.93,51.58 ; 29.41,51.58 29.84,51.58 ; Designator#385.2 56.7,79.47 ; 56.7,79.47 arc(56.56,79.14) 56.24,79.01 ; 29.39,79.45 29.39,79.03 29.41,79.01 ; 29.39,79.45 29.39,79.47 ; 29.39,79.45 arc(29.52,79.14) 29.84,79.01 ; 29.39,52.02 29.39,52.04 ; 29.39,52.02 arc(29.52,51.7) 29.84,51.58 ; Designator#827.27 28.72,30.65 27.84,31.53 27.84,37.17 28.17,37.49 28.35,37.49 28.72,37.86 28.93,37.86 ; 28.93,24.14 28.72,24.14 28.35,23.78 28.17,23.78 27.84,23.45 27.84,17.81 28.72,16.93 Designator#321.27 ; 28.93,24.14 29.41,24.14 ; 28.93,24.14 arc(29.26,24.28) 29.39,24.6 ; 29.39,38.3 29.39,37.88 29.41,37.86 ; 29.39,38.3 arc(29.52,37.99) 29.84,37.86 ; 57.14,79.01 56.72,79.01 ; 57.14,79.01 Designator#814.24 ; 56.72,79.01 56.24,79.01 ; Designator#829.27 56.03,16.93 55.15,17.81 55.15,23.45 55.48,23.78 55.66,23.78 56.02,24.14 56.24,24.14 ; 2.11,37.86 1.63,37.86 ; 2.11,37.86 2.09,37.88 2.09,38.3 ; 2.11,37.86 2.53,37.86 ; 1.63,37.86 1.41,37.86 1.05,37.49 0.87,37.49 0.54,37.17 0.54,31.53 1.42,30.65 Designator#440.27 ; 1.63,37.86 arc(1.95,37.99) 2.09,38.32 ; Designator#317.24 2.53,37.86 ; 2.53,37.86 arc(2.22,37.99) 2.09,38.3 ; 28.93,51.58 28.72,51.58 28.35,51.21 28.17,51.21 27.84,50.88 27.84,45.24 28.72,44.36 Designator#916.27 ; 28.93,51.58 arc(29.26,51.71) 29.39,52.04 ; Designator#919.24 57.14,37.86 ; 57.14,37.86 56.72,37.86 ; 57.14,37.86 arc(56.83,37.99) 56.7,38.3 ; 56.72,37.86 56.24,37.86 ; 56.72,37.86 56.7,37.88 56.7,38.3 ; 56.24,37.86 56.02,37.86 55.66,37.49 55.48,37.49 55.15,37.17 55.15,31.53 56.03,30.65 Designator#892.27 ; Designator#370.2 29.39,10.89 ; 29.39,10.89 29.39,10.87 ; 29.39,10.89 arc(29.26,10.56) 28.93,10.43 ; 28.93,37.86 29.41,37.86 ; Designator#921.24 29.84,37.86 ; 29.84,37.86 29.41,37.86 ; 2.53,24.14 2.11,24.14 ; 2.53,24.14 Designator#318.24 ; 2.11,24.14 1.63,24.14 ; Designator#319.24 29.84,51.58 ; 2.09,38.32 2.09,38.3 ; 2.09,38.32 Designator#433.2 ; Designator#903.27 56.03,71.8 55.15,72.67 55.15,78.31 55.48,78.64 55.66,78.64 56.02,79.01 56.24,79.01 ; 56.72,10.43 56.24,10.43 ; 56.72,10.43 57.14,10.43 ; 56.72,10.43 56.7,10.45 56.7,10.87 ; 56.24,10.43 56.02,10.43 55.66,10.06 55.48,10.06 55.15,9.73 55.15,4.09 56.03,3.22 Designator#832.27 ; 56.24,10.43 arc(56.56,10.56) 56.7,10.89 ; 57.14,10.43 Designator#911.24 ; 57.14,10.43 arc(56.83,10.56) 56.7,10.87 ; Designator#421.2 29.39,52.04 ; 2.11,79.01 1.63,79.01 ; 2.11,79.01 2.53,79.01 ; 2.11,79.01 2.09,79.03 2.09,79.45 ; 1.63,79.01 1.41,79.01 1.05,78.64 0.87,78.64 0.54,78.31 0.54,72.67 1.42,71.8 Designator#325.27 ; 1.63,79.01 arc(1.95,79.14) 2.09,79.47 ; 2.09,79.45 2.09,79.47 ; 2.09,79.45 arc(2.22,79.14) 2.53,79.01 ; 56.7,10.89 56.7,10.87 ; 56.7,10.89 Designator#376.2 ; Designator#878.24 29.84,65.29 ; 29.84,65.29 29.41,65.29 ; 29.84,65.29 arc(29.52,65.42) 29.39,65.73 ; 1.63,51.58 1.41,51.58 1.05,51.21 0.87,51.21 0.54,50.88 0.54,45.24 1.42,44.36 Designator#803.27 ; 1.63,51.58 arc(1.95,51.71) 2.09,52.04 ; 2.53,51.58 Designator#888.24 ; 2.53,51.58 arc(2.22,51.7) 2.09,52.02 ; 56.7,52.04 56.7,52.02 ; 56.7,52.04 Designator#427.2 ; 56.7,52.02 arc(56.83,51.7) 57.14,51.58 ; 57.14,51.58 Designator#877.24 ; Designator#901.24 29.84,79.01 ; 29.84,79.01 29.41,79.01 ; 29.41,24.14 29.84,24.14 ; 29.41,24.14 29.39,24.16 29.39,24.59 ; Designator#415.2 2.09,52.04 ; 2.09,52.04 2.09,52.02 ; 1.63,24.14 1.41,24.14 1.05,23.78 0.87,23.78 0.54,23.45 0.54,17.81 1.42,16.93 Designator#837.27 ; 56.72,65.29 56.24,65.29 ; 56.72,65.29 57.14,65.29 ; 56.24,65.29 56.02,65.29 55.66,64.93 55.48,64.93 55.15,64.6 55.15,58.96 56.03,58.08 Designator#896.27 ; 56.24,65.29 arc(56.56,65.43) 56.7,65.75 ; Designator#397.2 2.09,65.75 ; 2.09,65.75 2.09,65.73 ; 2.09,65.75 arc(1.95,65.43) 1.63,65.29 ; 56.7,65.75 Designator#409.2 ; 2.11,65.29 1.63,65.29 ; 2.11,65.29 2.53,65.29 ; 2.11,65.29 2.09,65.31 2.09,65.73 ; 1.63,65.29 1.41,65.29 1.05,64.93 0.87,64.93 0.54,64.6 0.54,58.96 1.42,58.08 Designator#811.27 ; Designator#382.2 2.09,79.47 ; 29.41,65.29 29.39,65.31 29.39,65.73 ; 29.39,79.47 Designator#391.2 ; 2.11,10.43 1.63,10.43 ; 2.11,10.43 2.09,10.45 2.09,10.87 ; 1.63,10.43 arc(1.95,10.56) 2.09,10.89 ; 2.53,79.01 Designator#437.24 ; 29.39,65.73 29.39,65.75 ; 2.09,10.89 2.09,10.87 ; 2.09,10.89 Designator#364.2 ; Designator#909.24 29.84,24.14 ; 29.84,24.14 arc(29.52,24.27) 29.39,24.59 ; Designator#359.2 56.7,24.6 ; 56.7,24.6 56.7,24.59 ; 56.7,24.6 arc(56.56,24.28) 56.24,24.14 ; Designator#353.2 29.39,24.6 ; 29.39,24.6 29.39,24.59 ; 2.53,65.29 Designator#818.24 ; 2.53,65.29 arc(2.22,65.42) 2.09,65.73 ; 56.7,24.59 56.7,24.16 56.72,24.14 ; 56.7,24.59 arc(56.83,24.27) 57.14,24.14 ; 57.14,65.29 Designator#819.24 ; 57.14,24.14 56.72,24.14 ; 57.14,24.14 Designator#900.24 ; 56.72,24.14 56.24,24.14 ; 29.39,65.75 Designator#403.2 ; 28.93,10.43 28.72,10.43 28.35,10.06 28.17,10.06 27.84,9.73 27.84,4.09 28.72,3.22 Designator#806.27